# EAGLE schematic Resistor_Resistor (EAGLE 8.3.0), part 33 of 43
## Nets (continued)
N$67: R11801.2 R11802.2 R11803.2 R11804.2 R11805.2 R11806.2 R11807.2 R11808.2 R11809.2 R11810.2 R11811.2 R11812.2 R11813.2 R11814.2 R11815.2 R11816.2 R11817.2 R11818.2 R11819.2 R11820.2 R11821.2 R11822.2 R11823.2 R11824.2 R11825.2 R11826.2 R11827.2 R11828.2 R11829.2 R11830.2 R11831.2 R11832.2 R11833.2 R11834.2 R11835.2 R11836.2 R11837.2 R11838.2 R11839.2 R11840.2 R11841.2 R11842.2 R11843.2 R11844.2 R11845.2 R11846.2 R11847.2 R11848.2 R11849.2 R11850.2 R11851.2 R11852.2 R11853.2 R11854.2 R11855.2 R11856.2 R11857.2 R11858.2 R11859.2 R11860.2 R11861.2 R11862.2 R11863.2 R11864.2 R11865.2 R11866.2 R11867.2 R11868.2 R11869.2 R11870.2 R11871.2 R11872.2 R11873.2 R11874.2 R11875.2 R11876.2 R11877.2 R11878.2 R11879.2 R11880.2 R11881.2 R11882.2 R11883.2 R11884.2 R11885.2 R11886.2 R11887.2 R11888.2 R11889.2 R11890.2 R11891.2 R11892.2 R11893.2 R11894.2 R11895.2 R11896.2 R11897.2 R11898.2 R11899.2 R11900.2 R11901.2 R11902.2 R11903.2 R11904.2 R11905.2 R11906.2 R11907.2 R11908.2 R11909.2 R11910.2 R11911.2 R11912.2 R11913.2 R11914.2 R11915.2 R11916.2 R11917.2 R11918.2 R11919.2 R11920.2 R11921.2 R11922.2 R11923.2 R11924.2 R11925.2 R11926.2 R11927.2 R11928.2 R11929.2 R11930.2 R11931.2 R11932.2 R11933.2 R11934.2 R11935.2 R11936.2 R11937.2 R11938.2 R11939.2 R11940.2 R11941.2 R11942.2 R11943.2 R11944.2 R11945.2 R11946.2 R11947.2 R11948.2 R11949.2 R11950.2 R11951.2 R11952.2 R11953.2 R11954.2 R11955.2 R11956.2 R11957.2 R11958.2 R11959.2 R11960.2 R11961.2 R11962.2 R11963.2 R11964.2 R11965.2 R11966.2 R11967.2 R11968.2 R11969.2 R11970.2 R11971.2 R11972.2 R11973.2 R11974.2 R11975.2 R11976.2 R11977.2 R11978.2 R11979.2 R11980.2 R11981.2 R11982.2 R11983.2 R11984.2 R11985.2 R11986.2 R11987.2 R11988.2 R11989.2 R11990.2 R11991.2 R11992.2 R11993.2 R11994.2 R11995.2 R11996.2 R11997.2 R11998.2 R11999.2 R12000.2 R12001.1 R12002.1 R12003.1 R12004.1 R12005.1 R12006.1 R12007.1 R12008.1 R12009.1 R12010.1 R12011.1 R12012.1 R12013.1 R12014.1 R12015.1 R12016.1 R12017.1 R12018.1 R12019.1 R12020.1 R12021.1 R12022.1 R12023.1 R12024.1 R12025.1 R12026.1 R12027.1 R12028.1 R12029.1 R12030.1 R12031.1 R12032.1 R12033.1 R12034.1 R12035.1 R12036.1 R12037.1 R12038.1 R12039.1 R12040.1 R12041.1 R12042.1 R12043.1 R12044.1 R12045.1 R12046.1 R12047.1 R12048.1 R12049.1 R12050.1 R12051.1 R12052.1 R12053.1 R12054.1 R12055.1 R12056.1 R12057.1 R12058.1 R12059.1 R12060.1 R12061.1 R12062.1 R12063.1 R12064.1 R12065.1 R12066.1 R12067.1 R12068.1 R12069.1 R12070.1 R12071.1 R12072.1 R12073.1 R12074.1 R12075.1 R12076.1 R12077.1 R12078.1 R12079.1 R12080.1 R12081.1 R12082.1 R12083.1 R12084.1 R12085.1 R12086.1 R12087.1 R12088.1 R12089.1 R12090.1 R12091.1 R12092.1 R12093.1 R12094.1 R12095.1 R12096.1 R12097.1 R12098.1 R12099.1 R12100.1 R12101.1 R12102.1 R12103.1 R12104.1 R12105.1 R12106.1 R12107.1 R12108.1 R12109.1 R12110.1 R12111.1 R12112.1 R12113.1 R12114.1 R12115.1 R12116.1 R12117.1 R12118.1 R12119.1 R12120.1 R12121.1 R12122.1 R12123.1 R12124.1 R12125.1 R12126.1 R12127.1 R12128.1 R12129.1 R12130.1 R12131.1 R12132.1 R12133.1 R12134.1 R12135.1 R12136.1 R12137.1 R12138.1 R12139.1 R12140.1 R12141.1 R12142.1 R12143.1 R12144.1 R12145.1 R12146.1 R12147.1 R12148.1 R12149.1 R12150.1 R12151.1 R12152.1 R12153.1 R12154.1 R12155.1 R12156.1 R12157.1 R12158.1 R12159.1 R12160.1 R12161.1 R12162.1 R12163.1 R12164.1 R12165.1 R12166.1 R12167.1 R12168.1 R12169.1 R12170.1 R12171.1 R12172.1 R12173.1 R12174.1 R12175.1 R12176.1 R12177.1 R12178.1 R12179.1 R12180.1 R12181.1 R12182.1 R12183.1 R12184.1 R12185.1 R12186.1 R12187.1 R12188.1 R12189.1 R12190.1 R12191.1 R12192.1 R12193.1 R12194.1 R12195.1 R12196.1 R12197.1 R12198.1 R12199.1 R12200.1
N$68: R12001.2 R12002.2 R12003.2 R12004.2 R12005.2 R12006.2 R12007.2 R12008.2 R12009.2 R12010.2 R12011.2 R12012.2 R12013.2 R12014.2 R12015.2 R12016.2 R12017.2 R12018.2 R12019.2 R12020.2 R12021.2 R12022.2 R12023.2 R12024.2 R12025.2 R12026.2 R12027.2 R12028.2 R12029.2 R12030.2 R12031.2 R12032.2 R12033.2 R12034.2 R12035.2 R12036.2 R12037.2 R12038.2 R12039.2 R12040.2 R12041.2 R12042.2 R12043.2 R12044.2 R12045.2 R12046.2 R12047.2 R12048.2 R12049.2 R12050.2 R12051.2 R12052.2 R12053.2 R12054.2 R12055.2 R12056.2 R12057.2 R12058.2 R12059.2 R12060.2 R12061.2 R12062.2 R12063.2 R12064.2 R12065.2 R12066.2 R12067.2 R12068.2 R12069.2 R12070.2 R12071.2 R12072.2 R12073.2 R12074.2 R12075.2 R12076.2 R12077.2 R12078.2 R12079.2 R12080.2 R12081.2 R12082.2 R12083.2 R12084.2 R12085.2 R12086.2 R12087.2 R12088.2 R12089.2 R12090.2 R12091.2 R12092.2 R12093.2 R12094.2 R12095.2 R12096.2 R12097.2 R12098.2 R12099.2 R12100.2 R12101.2 R12102.2 R12103.2 R12104.2 R12105.2 R12106.2 R12107.2 R12108.2 R12109.2 R12110.2 R12111.2 R12112.2 R12113.2 R12114.2 R12115.2 R12116.2 R12117.2 R12118.2 R12119.2 R12120.2 R12121.2 R12122.2 R12123.2 R12124.2 R12125.2 R12126.2 R12127.2 R12128.2 R12129.2 R12130.2 R12131.2 R12132.2 R12133.2 R12134.2 R12135.2 R12136.2 R12137.2 R12138.2 R12139.2 R12140.2 R12141.2 R12142.2 R12143.2 R12144.2 R12145.2 R12146.2 R12147.2 R12148.2 R12149.2 R12150.2 R12151.2 R12152.2 R12153.2 R12154.2 R12155.2 R12156.2 R12157.2 R12158.2 R12159.2 R12160.2 R12161.2 R12162.2 R12163.2 R12164.2 R12165.2 R12166.2 R12167.2 R12168.2 R12169.2 R12170.2 R12171.2 R12172.2 R12173.2 R12174.2 R12175.2 R12176.2 R12177.2 R12178.2 R12179.2 R12180.2 R12181.2 R12182.2 R12183.2 R12184.2 R12185.2 R12186.2 R12187.2 R12188.2 R12189.2 R12190.2 R12191.2 R12192.2 R12193.2 R12194.2 R12195.2 R12196.2 R12197.2 R12198.2 R12199.2 R12200.2 R12201.1 R12202.1 R12203.1 R12204.1 R12205.1 R12206.1 R12207.1 R12208.1 R12209.1 R12210.1 R12211.1 R12212.1 R12213.1 R12214.1 R12215.1 R12216.1 R12217.1 R12218.1 R12219.1 R12220.1 R12221.1 R12222.1 R12223.1 R12224.1 R12225.1 R12226.1 R12227.1 R12228.1 R12229.1 R12230.1 R12231.1 R12232.1 R12233.1 R12234.1 R12235.1 R12236.1 R12237.1 R12238.1 R12239.1 R12240.1 R12241.1 R12242.1 R12243.1 R12244.1 R12245.1 R12246.1 R12247.1 R12248.1 R12249.1 R12250.1 R12251.1 R12252.1 R12253.1 R12254.1 R12255.1 R12256.1 R12257.1 R12258.1 R12259.1 R12260.1 R12261.1 R12262.1 R12263.1 R12264.1 R12265.1 R12266.1 R12267.1 R12268.1 R12269.1 R12270.1 R12271.1 R12272.1 R12273.1 R12274.1 R12275.1 R12276.1 R12277.1 R12278.1 R12279.1 R12280.1 R12281.1 R12282.1 R12283.1 R12284.1 R12285.1 R12286.1 R12287.1 R12288.1 R12289.1 R12290.1 R12291.1 R12292.1 R12293.1 R12294.1 R12295.1 R12296.1 R12297.1 R12298.1 R12299.1 R12300.1 R12301.1 R12302.1 R12303.1 R12304.1 R12305.1 R12306.1 R12307.1 R12308.1 R12309.1 R12310.1 R12311.1 R12312.1 R12313.1 R12314.1 R12315.1 R12316.1 R12317.1 R12318.1 R12319.1 R12320.1 R12321.1 R12322.1 R12323.1 R12324.1 R12325.1 R12326.1 R12327.1 R12328.1 R12329.1 R12330.1 R12331.1 R12332.1 R12333.1 R12334.1 R12335.1 R12336.1 R12337.1 R12338.1 R12339.1 R12340.1 R12341.1 R12342.1 R12343.1 R12344.1 R12345.1 R12346.1 R12347.1 R12348.1 R12349.1 R12350.1 R12351.1 R12352.1 R12353.1 R12354.1 R12355.1 R12356.1 R12357.1 R12358.1 R12359.1 R12360.1 R12361.1 R12362.1 R12363.1 R12364.1 R12365.1 R12366.1 R12367.1 R12368.1 R12369.1 R12370.1 R12371.1 R12372.1 R12373.1 R12374.1 R12375.1 R12376.1 R12377.1 R12378.1 R12379.1 R12380.1 R12381.1 R12382.1 R12383.1 R12384.1 R12385.1 R12386.1 R12387.1 R12388.1 R12389.1 R12390.1 R12391.1 R12392.1 R12393.1 R12394.1 R12395.1 R12396.1 R12397.1 R12398.1 R12399.1 R12400.1
N$69: R12201.2 R12202.2 R12203.2 R12204.2 R12205.2 R12206.2 R12207.2 R12208.2 R12209.2 R12210.2 R12211.2 R12212.2 R12213.2 R12214.2 R12215.2 R12216.2 R12217.2 R12218.2 R12219.2 R12220.2 R12221.2 R12222.2 R12223.2 R12224.2 R12225.2 R12226.2 R12227.2 R12228.2 R12229.2 R12230.2 R12231.2 R12232.2 R12233.2 R12234.2 R12235.2 R12236.2 R12237.2 R12238.2 R12239.2 R12240.2 R12241.2 R12242.2 R12243.2 R12244.2 R12245.2 R12246.2 R12247.2 R12248.2 R12249.2 R12250.2 R12251.2 R12252.2 R12253.2 R12254.2 R12255.2 R12256.2 R12257.2 R12258.2 R12259.2 R12260.2 R12261.2 R12262.2 R12263.2 R12264.2 R12265.2 R12266.2 R12267.2 R12268.2 R12269.2 R12270.2 R12271.2 R12272.2 R12273.2 R12274.2 R12275.2 R12276.2 R12277.2 R12278.2 R12279.2 R12280.2 R12281.2 R12282.2 R12283.2 R12284.2 R12285.2 R12286.2 R12287.2 R12288.2 R12289.2 R12290.2 R12291.2 R12292.2 R12293.2 R12294.2 R12295.2 R12296.2 R12297.2 R12298.2 R12299.2 R12300.2 R12301.2 R12302.2 R12303.2 R12304.2 R12305.2 R12306.2 R12307.2 R12308.2 R12309.2 R12310.2 R12311.2 R12312.2 R12313.2 R12314.2 R12315.2 R12316.2 R12317.2 R12318.2 R12319.2 R12320.2 R12321.2 R12322.2 R12323.2 R12324.2 R12325.2 R12326.2 R12327.2 R12328.2 R12329.2 R12330.2 R12331.2 R12332.2 R12333.2 R12334.2 R12335.2 R12336.2 R12337.2 R12338.2 R12339.2 R12340.2 R12341.2 R12342.2 R12343.2 R12344.2 R12345.2 R12346.2 R12347.2 R12348.2 R12349.2 R12350.2 R12351.2 R12352.2 R12353.2 R12354.2 R12355.2 R12356.2 R12357.2 R12358.2 R12359.2 R12360.2 R12361.2 R12362.2 R12363.2 R12364.2 R12365.2 R12366.2 R12367.2 R12368.2 R12369.2 R12370.2 R12371.2 R12372.2 R12373.2 R12374.2 R12375.2 R12376.2 R12377.2 R12378.2 R12379.2 R12380.2 R12381.2 R12382.2 R12383.2 R12384.2 R12385.2 R12386.2 R12387.2 R12388.2 R12389.2 R12390.2 R12391.2 R12392.2 R12393.2 R12394.2 R12395.2 R12396.2 R12397.2 R12398.2 R12399.2 R12400.2 R12401.1 R12402.1 R12403.1 R12404.1 R12405.1 R12406.1 R12407.1 R12408.1 R12409.1 R12410.1 R12411.1 R12412.1 R12413.1 R12414.1 R12415.1 R12416.1 R12417.1 R12418.1 R12419.1 R12420.1 R12421.1 R12422.1 R12423.1 R12424.1 R12425.1 R12426.1 R12427.1 R12428.1 R12429.1 R12430.1 R12431.1 R12432.1 R12433.1 R12434.1 R12435.1 R12436.1 R12437.1 R12438.1 R12439.1 R12440.1 R12441.1 R12442.1 R12443.1 R12444.1 R12445.1 R12446.1 R12447.1 R12448.1 R12449.1 R12450.1 R12451.1 R12452.1 R12453.1 R12454.1 R12455.1 R12456.1 R12457.1 R12458.1 R12459.1 R12460.1 R12461.1 R12462.1 R12463.1 R12464.1 R12465.1 R12466.1 R12467.1 R12468.1 R12469.1 R12470.1 R12471.1 R12472.1 R12473.1 R12474.1 R12475.1 R12476.1 R12477.1 R12478.1 R12479.1 R12480.1 R12481.1 R12482.1 R12483.1 R12484.1 R12485.1 R12486.1 R12487.1 R12488.1 R12489.1 R12490.1 R12491.1 R12492.1 R12493.1 R12494.1 R12495.1 R12496.1 R12497.1 R12498.1 R12499.1 R12500.1 R12501.1 R12502.1 R12503.1 R12504.1 R12505.1 R12506.1 R12507.1 R12508.1 R12509.1 R12510.1 R12511.1 R12512.1 R12513.1 R12514.1 R12515.1 R12516.1 R12517.1 R12518.1 R12519.1 R12520.1 R12521.1 R12522.1 R12523.1 R12524.1 R12525.1 R12526.1 R12527.1 R12528.1 R12529.1 R12530.1 R12531.1 R12532.1 R12533.1 R12534.1 R12535.1 R12536.1 R12537.1 R12538.1 R12539.1 R12540.1 R12541.1 R12542.1 R12543.1 R12544.1 R12545.1 R12546.1 R12547.1 R12548.1 R12549.1 R12550.1 R12551.1 R12552.1 R12553.1 R12554.1 R12555.1 R12556.1 R12557.1 R12558.1 R12559.1 R12560.1 R12561.1 R12562.1 R12563.1 R12564.1 R12565.1 R12566.1 R12567.1 R12568.1 R12569.1 R12570.1 R12571.1 R12572.1 R12573.1 R12574.1 R12575.1 R12576.1 R12577.1 R12578.1 R12579.1 R12580.1 R12581.1 R12582.1 R12583.1 R12584.1 R12585.1 R12586.1 R12587.1 R12588.1 R12589.1 R12590.1 R12591.1 R12592.1 R12593.1 R12594.1 R12595.1 R12596.1 R12597.1 R12598.1 R12599.1 R12600.1
N$70: R12401.2 R12402.2 R12403.2 R12404.2 R12405.2 R12406.2 R12407.2 R12408.2 R12409.2 R12410.2 R12411.2 R12412.2 R12413.2 R12414.2 R12415.2 R12416.2 R12417.2 R12418.2 R12419.2 R12420.2 R12421.2 R12422.2 R12423.2 R12424.2 R12425.2 R12426.2 R12427.2 R12428.2 R12429.2 R12430.2 R12431.2 R12432.2 R12433.2 R12434.2 R12435.2 R12436.2 R12437.2 R12438.2 R12439.2 R12440.2 R12441.2 R12442.2 R12443.2 R12444.2 R12445.2 R12446.2 R12447.2 R12448.2 R12449.2 R12450.2 R12451.2 R12452.2 R12453.2 R12454.2 R12455.2 R12456.2 R12457.2 R12458.2 R12459.2 R12460.2 R12461.2 R12462.2 R12463.2 R12464.2 R12465.2 R12466.2 R12467.2 R12468.2 R12469.2 R12470.2 R12471.2 R12472.2 R12473.2 R12474.2 R12475.2 R12476.2 R12477.2 R12478.2 R12479.2 R12480.2 R12481.2 R12482.2 R12483.2 R12484.2 R12485.2 R12486.2 R12487.2 R12488.2 R12489.2 R12490.2 R12491.2 R12492.2 R12493.2 R12494.2 R12495.2 R12496.2 R12497.2 R12498.2 R12499.2 R12500.2 R12501.2 R12502.2 R12503.2 R12504.2 R12505.2 R12506.2 R12507.2 R12508.2 R12509.2 R12510.2 R12511.2 R12512.2 R12513.2 R12514.2 R12515.2 R12516.2 R12517.2 R12518.2 R12519.2 R12520.2 R12521.2 R12522.2 R12523.2 R12524.2 R12525.2 R12526.2 R12527.2 R12528.2 R12529.2 R12530.2 R12531.2 R12532.2 R12533.2 R12534.2 R12535.2 R12536.2 R12537.2 R12538.2 R12539.2 R12540.2 R12541.2 R12542.2 R12543.2 R12544.2 R12545.2 R12546.2 R12547.2 R12548.2 R12549.2 R12550.2 R12551.2 R12552.2 R12553.2 R12554.2 R12555.2 R12556.2 R12557.2 R12558.2 R12559.2 R12560.2 R12561.2 R12562.2 R12563.2 R12564.2 R12565.2 R12566.2 R12567.2 R12568.2 R12569.2 R12570.2 R12571.2 R12572.2 R12573.2 R12574.2 R12575.2 R12576.2 R12577.2 R12578.2 R12579.2 R12580.2 R12581.2 R12582.2 R12583.2 R12584.2 R12585.2 R12586.2 R12587.2 R12588.2 R12589.2 R12590.2 R12591.2 R12592.2 R12593.2 R12594.2 R12595.2 R12596.2 R12597.2 R12598.2 R12599.2 R12600.2 R12601.1 R12602.1 R12603.1 R12604.1 R12605.1 R12606.1 R12607.1 R12608.1 R12609.1 R12610.1 R12611.1 R12612.1 R12613.1 R12614.1 R12615.1 R12616.1 R12617.1 R12618.1 R12619.1 R12620.1 R12621.1 R12622.1 R12623.1 R12624.1 R12625.1 R12626.1 R12627.1 R12628.1 R12629.1 R12630.1 R12631.1 R12632.1 R12633.1 R12634.1 R12635.1 R12636.1 R12637.1 R12638.1 R12639.1 R12640.1 R12641.1 R12642.1 R12643.1 R12644.1 R12645.1 R12646.1 R12647.1 R12648.1 R12649.1 R12650.1 R12651.1 R12652.1 R12653.1 R12654.1 R12655.1 R12656.1 R12657.1 R12658.1 R12659.1 R12660.1 R12661.1 R12662.1 R12663.1 R12664.1 R12665.1 R12666.1 R12667.1 R12668.1 R12669.1 R12670.1 R12671.1 R12672.1 R12673.1 R12674.1 R12675.1 R12676.1 R12677.1 R12678.1 R12679.1 R12680.1 R12681.1 R12682.1 R12683.1 R12684.1 R12685.1 R12686.1 R12687.1 R12688.1 R12689.1 R12690.1 R12691.1 R12692.1 R12693.1 R12694.1 R12695.1 R12696.1 R12697.1 R12698.1 R12699.1 R12700.1 R12701.1 R12702.1 R12703.1 R12704.1 R12705.1 R12706.1 R12707.1 R12708.1 R12709.1 R12710.1 R12711.1 R12712.1 R12713.1 R12714.1 R12715.1 R12716.1 R12717.1 R12718.1 R12719.1 R12720.1 R12721.1 R12722.1 R12723.1 R12724.1 R12725.1 R12726.1 R12727.1 R12728.1 R12729.1 R12730.1 R12731.1 R12732.1 R12733.1 R12734.1 R12735.1 R12736.1 R12737.1 R12738.1 R12739.1 R12740.1 R12741.1 R12742.1 R12743.1 R12744.1 R12745.1 R12746.1 R12747.1 R12748.1 R12749.1 R12750.1 R12751.1 R12752.1 R12753.1 R12754.1 R12755.1 R12756.1 R12757.1 R12758.1 R12759.1 R12760.1 R12761.1 R12762.1 R12763.1 R12764.1 R12765.1 R12766.1 R12767.1 R12768.1 R12769.1 R12770.1 R12771.1 R12772.1 R12773.1 R12774.1 R12775.1 R12776.1 R12777.1 R12778.1 R12779.1 R12780.1 R12781.1 R12782.1 R12783.1 R12784.1 R12785.1 R12786.1 R12787.1 R12788.1 R12789.1 R12790.1 R12791.1 R12792.1 R12793.1 R12794.1 R12795.1 R12796.1 R12797.1 R12798.1 R12799.1 R12800.1
N$71: R12601.2 R12602.2 R12603.2 R12604.2 R12605.2 R12606.2 R12607.2 R12608.2 R12609.2 R12610.2 R12611.2 R12612.2 R12613.2 R12614.2 R12615.2 R12616.2 R12617.2 R12618.2 R12619.2 R12620.2 R12621.2 R12622.2 R12623.2 R12624.2 R12625.2 R12626.2 R12627.2 R12628.2 R12629.2 R12630.2 R12631.2 R12632.2 R12633.2 R12634.2 R12635.2 R12636.2 R12637.2 R12638.2 R12639.2 R12640.2 R12641.2 R12642.2 R12643.2 R12644.2 R12645.2 R12646.2 R12647.2 R12648.2 R12649.2 R12650.2 R12651.2 R12652.2 R12653.2 R12654.2 R12655.2 R12656.2 R12657.2 R12658.2 R12659.2 R12660.2 R12661.2 R12662.2 R12663.2 R12664.2 R12665.2 R12666.2 R12667.2 R12668.2 R12669.2 R12670.2 R12671.2 R12672.2 R12673.2 R12674.2 R12675.2 R12676.2 R12677.2 R12678.2 R12679.2 R12680.2 R12681.2 R12682.2 R12683.2 R12684.2 R12685.2 R12686.2 R12687.2 R12688.2 R12689.2 R12690.2 R12691.2 R12692.2 R12693.2 R12694.2 R12695.2 R12696.2 R12697.2 R12698.2 R12699.2 R12700.2 R12701.2 R12702.2 R12703.2 R12704.2 R12705.2 R12706.2 R12707.2 R12708.2 R12709.2 R12710.2 R12711.2 R12712.2 R12713.2 R12714.2 R12715.2 R12716.2 R12717.2 R12718.2 R12719.2 R12720.2 R12721.2 R12722.2 R12723.2 R12724.2 R12725.2 R12726.2 R12727.2 R12728.2 R12729.2 R12730.2 R12731.2 R12732.2 R12733.2 R12734.2 R12735.2 R12736.2 R12737.2 R12738.2 R12739.2 R12740.2 R12741.2 R12742.2 R12743.2 R12744.2 R12745.2 R12746.2 R12747.2 R12748.2 R12749.2 R12750.2 R12751.2 R12752.2 R12753.2 R12754.2 R12755.2 R12756.2 R12757.2 R12758.2 R12759.2 R12760.2 R12761.2 R12762.2 R12763.2 R12764.2 R12765.2 R12766.2 R12767.2 R12768.2 R12769.2 R12770.2 R12771.2 R12772.2 R12773.2 R12774.2 R12775.2 R12776.2 R12777.2 R12778.2 R12779.2 R12780.2 R12781.2 R12782.2 R12783.2 R12784.2 R12785.2 R12786.2 R12787.2 R12788.2 R12789.2 R12790.2 R12791.2 R12792.2 R12793.2 R12794.2 R12795.2 R12796.2 R12797.2 R12798.2 R12799.2 R12800.2 R12801.1 R12802.1 R12803.1 R12804.1 R12805.1 R12806.1 R12807.1 R12808.1 R12809.1 R12810.1 R12811.1 R12812.1 R12813.1 R12814.1 R12815.1 R12816.1 R12817.1 R12818.1 R12819.1 R12820.1 R12821.1 R12822.1 R12823.1 R12824.1 R12825.1 R12826.1 R12827.1 R12828.1 R12829.1 R12830.1 R12831.1 R12832.1 R12833.1 R12834.1 R12835.1 R12836.1 R12837.1 R12838.1 R12839.1 R12840.1 R12841.1 R12842.1 R12843.1 R12844.1 R12845.1 R12846.1 R12847.1 R12848.1 R12849.1 R12850.1 R12851.1 R12852.1 R12853.1 R12854.1 R12855.1 R12856.1 R12857.1 R12858.1 R12859.1 R12860.1 R12861.1 R12862.1 R12863.1 R12864.1 R12865.1 R12866.1 R12867.1 R12868.1 R12869.1 R12870.1 R12871.1 R12872.1 R12873.1 R12874.1 R12875.1 R12876.1 R12877.1 R12878.1 R12879.1 R12880.1 R12881.1 R12882.1 R12883.1 R12884.1 R12885.1 R12886.1 R12887.1 R12888.1 R12889.1 R12890.1 R12891.1 R12892.1 R12893.1 R12894.1 R12895.1 R12896.1 R12897.1 R12898.1 R12899.1 R12900.1 R12901.1 R12902.1 R12903.1 R12904.1 R12905.1 R12906.1 R12907.1 R12908.1 R12909.1 R12910.1 R12911.1 R12912.1 R12913.1 R12914.1 R12915.1 R12916.1 R12917.1 R12918.1 R12919.1 R12920.1 R12921.1 R12922.1 R12923.1 R12924.1 R12925.1 R12926.1 R12927.1 R12928.1 R12929.1 R12930.1 R12931.1 R12932.1 R12933.1 R12934.1 R12935.1 R12936.1 R12937.1 R12938.1 R12939.1 R12940.1 R12941.1 R12942.1 R12943.1 R12944.1 R12945.1 R12946.1 R12947.1 R12948.1 R12949.1 R12950.1 R12951.1 R12952.1 R12953.1 R12954.1 R12955.1 R12956.1 R12957.1 R12958.1 R12959.1 R12960.1 R12961.1 R12962.1 R12963.1 R12964.1 R12965.1 R12966.1 R12967.1 R12968.1 R12969.1 R12970.1 R12971.1 R12972.1 R12973.1 R12974.1 R12975.1 R12976.1 R12977.1 R12978.1 R12979.1 R12980.1 R12981.1 R12982.1 R12983.1 R12984.1 R12985.1 R12986.1 R12987.1 R12988.1 R12989.1 R12990.1 R12991.1 R12992.1 R12993.1 R12994.1 R12995.1 R12996.1 R12997.1 R12998.1 R12999.1 R13000.1
N$73: R12801.2 R12802.2 R12803.2 R12804.2 R12805.2 R12806.2 R12807.2 R12808.2 R12809.2 R12810.2 R12811.2 R12812.2 R12813.2 R12814.2 R12815.2 R12816.2 R12817.2 R12818.2 R12819.2 R12820.2 R12821.2 R12822.2 R12823.2 R12824.2 R12825.2 R12826.2 R12827.2 R12828.2 R12829.2 R12830.2 R12831.2 R12832.2 R12833.2 R12834.2 R12835.2 R12836.2 R12837.2 R12838.2 R12839.2 R12840.2 R12841.2 R12842.2 R12843.2 R12844.2 R12845.2 R12846.2 R12847.2 R12848.2 R12849.2 R12850.2 R12851.2 R12852.2 R12853.2 R12854.2 R12855.2 R12856.2 R12857.2 R12858.2 R12859.2 R12860.2 R12861.2 R12862.2 R12863.2 R12864.2 R12865.2 R12866.2 R12867.2 R12868.2 R12869.2 R12870.2 R12871.2 R12872.2 R12873.2 R12874.2 R12875.2 R12876.2 R12877.2 R12878.2 R12879.2 R12880.2 R12881.2 R12882.2 R12883.2 R12884.2 R12885.2 R12886.2 R12887.2 R12888.2 R12889.2 R12890.2 R12891.2 R12892.2 R12893.2 R12894.2 R12895.2 R12896.2 R12897.2 R12898.2 R12899.2 R12900.2 R12901.2 R12902.2 R12903.2 R12904.2 R12905.2 R12906.2 R12907.2 R12908.2 R12909.2 R12910.2 R12911.2 R12912.2 R12913.2 R12914.2 R12915.2 R12916.2 R12917.2 R12918.2 R12919.2 R12920.2 R12921.2 R12922.2 R12923.2 R12924.2 R12925.2 R12926.2 R12927.2 R12928.2 R12929.2 R12930.2 R12931.2 R12932.2 R12933.2 R12934.2 R12935.2 R12936.2 R12937.2 R12938.2 R12939.2 R12940.2 R12941.2 R12942.2 R12943.2 R12944.2 R12945.2 R12946.2 R12947.2 R12948.2 R12949.2 R12950.2 R12951.2 R12952.2 R12953.2 R12954.2 R12955.2 R12956.2 R12957.2 R12958.2 R12959.2 R12960.2 R12961.2 R12962.2 R12963.2 R12964.2 R12965.2 R12966.2 R12967.2 R12968.2 R12969.2 R12970.2 R12971.2 R12972.2 R12973.2 R12974.2 R12975.2 R12976.2 R12977.2 R12978.2 R12979.2 R12980.2 R12981.2 R12982.2 R12983.2 R12984.2 R12985.2 R12986.2 R12987.2 R12988.2 R12989.2 R12990.2 R12991.2 R12992.2 R12993.2 R12994.2 R12995.2 R12996.2 R12997.2 R12998.2 R12999.2 R13000.2 R13001.1 R13002.1 R13003.1 R13004.1 R13005.1 R13006.1 R13007.1 R13008.1 R13009.1 R13010.1 R13011.1 R13012.1 R13013.1 R13014.1 R13015.1 R13016.1 R13017.1 R13018.1 R13019.1 R13020.1 R13021.1 R13022.1 R13023.1 R13024.1 R13025.1 R13026.1 R13027.1 R13028.1 R13029.1 R13030.1 R13031.1 R13032.1 R13033.1 R13034.1 R13035.1 R13036.1 R13037.1 R13038.1 R13039.1 R13040.1 R13041.1 R13042.1 R13043.1 R13044.1 R13045.1 R13046.1 R13047.1 R13048.1 R13049.1 R13050.1 R13051.1 R13052.1 R13053.1 R13054.1 R13055.1 R13056.1 R13057.1 R13058.1 R13059.1 R13060.1 R13061.1 R13062.1 R13063.1 R13064.1 R13065.1 R13066.1 R13067.1 R13068.1 R13069.1 R13070.1 R13071.1 R13072.1 R13073.1 R13074.1 R13075.1 R13076.1 R13077.1 R13078.1 R13079.1 R13080.1 R13081.1 R13082.1 R13083.1 R13084.1 R13085.1 R13086.1 R13087.1 R13088.1 R13089.1 R13090.1 R13091.1 R13092.1 R13093.1 R13094.1 R13095.1 R13096.1 R13097.1 R13098.1 R13099.1 R13100.1 R13101.1 R13102.1 R13103.1 R13104.1 R13105.1 R13106.1 R13107.1 R13108.1 R13109.1 R13110.1 R13111.1 R13112.1 R13113.1 R13114.1 R13115.1 R13116.1 R13117.1 R13118.1 R13119.1 R13120.1 R13121.1 R13122.1 R13123.1 R13124.1 R13125.1 R13126.1 R13127.1 R13128.1 R13129.1 R13130.1 R13131.1 R13132.1 R13133.1 R13134.1 R13135.1 R13136.1 R13137.1 R13138.1 R13139.1 R13140.1 R13141.1 R13142.1 R13143.1 R13144.1 R13145.1 R13146.1 R13147.1 R13148.1 R13149.1 R13150.1 R13151.1 R13152.1 R13153.1 R13154.1 R13155.1 R13156.1 R13157.1 R13158.1 R13159.1 R13160.1 R13161.1 R13162.1 R13163.1 R13164.1 R13165.1 R13166.1 R13167.1 R13168.1 R13169.1 R13170.1 R13171.1 R13172.1 R13173.1 R13174.1 R13175.1 R13176.1 R13177.1 R13178.1 R13179.1 R13180.1 R13181.1 R13182.1 R13183.1 R13184.1 R13185.1 R13186.1 R13187.1 R13188.1 R13189.1 R13190.1 R13191.1 R13192.1 R13193.1 R13194.1 R13195.1 R13196.1 R13197.1 R13198.1 R13199.1 R13200.1
N$74: R13001.2 R13002.2 R13003.2 R13004.2 R13005.2 R13006.2 R13007.2 R13008.2 R13009.2 R13010.2 R13011.2 R13012.2 R13013.2 R13014.2 R13015.2 R13016.2 R13017.2 R13018.2 R13019.2 R13020.2 R13021.2 R13022.2 R13023.2 R13024.2 R13025.2 R13026.2 R13027.2 R13028.2 R13029.2 R13030.2 R13031.2 R13032.2 R13033.2 R13034.2 R13035.2 R13036.2 R13037.2 R13038.2 R13039.2 R13040.2 R13041.2 R13042.2 R13043.2 R13044.2 R13045.2 R13046.2 R13047.2 R13048.2 R13049.2 R13050.2 R13051.2 R13052.2 R13053.2 R13054.2 R13055.2 R13056.2 R13057.2 R13058.2 R13059.2 R13060.2 R13061.2 R13062.2 R13063.2 R13064.2 R13065.2 R13066.2 R13067.2 R13068.2 R13069.2 R13070.2 R13071.2 R13072.2 R13073.2 R13074.2 R13075.2 R13076.2 R13077.2 R13078.2 R13079.2 R13080.2 R13081.2 R13082.2 R13083.2 R13084.2 R13085.2 R13086.2 R13087.2 R13088.2 R13089.2 R13090.2 R13091.2 R13092.2 R13093.2 R13094.2 R13095.2 R13096.2 R13097.2 R13098.2 R13099.2 R13100.2 R13101.2 R13102.2 R13103.2 R13104.2 R13105.2 R13106.2 R13107.2 R13108.2 R13109.2 R13110.2 R13111.2 R13112.2 R13113.2 R13114.2 R13115.2 R13116.2 R13117.2 R13118.2 R13119.2 R13120.2 R13121.2 R13122.2 R13123.2 R13124.2 R13125.2 R13126.2 R13127.2 R13128.2 R13129.2 R13130.2 R13131.2 R13132.2 R13133.2 R13134.2 R13135.2 R13136.2 R13137.2 R13138.2 R13139.2 R13140.2 R13141.2 R13142.2 R13143.2 R13144.2 R13145.2 R13146.2 R13147.2 R13148.2 R13149.2 R13150.2 R13151.2 R13152.2 R13153.2 R13154.2 R13155.2 R13156.2 R13157.2 R13158.2 R13159.2 R13160.2 R13161.2 R13162.2 R13163.2 R13164.2 R13165.2 R13166.2 R13167.2 R13168.2 R13169.2 R13170.2 R13171.2 R13172.2 R13173.2 R13174.2 R13175.2 R13176.2 R13177.2 R13178.2 R13179.2 R13180.2 R13181.2 R13182.2 R13183.2 R13184.2 R13185.2 R13186.2 R13187.2 R13188.2 R13189.2 R13190.2 R13191.2 R13192.2 R13193.2 R13194.2 R13195.2 R13196.2 R13197.2 R13198.2 R13199.2 R13200.2 R13201.1 R13202.1 R13203.1 R13204.1 R13205.1 R13206.1 R13207.1 R13208.1 R13209.1 R13210.1 R13211.1 R13212.1 R13213.1 R13214.1 R13215.1 R13216.1 R13217.1 R13218.1 R13219.1 R13220.1 R13221.1 R13222.1 R13223.1 R13224.1 R13225.1 R13226.1 R13227.1 R13228.1 R13229.1 R13230.1 R13231.1 R13232.1 R13233.1 R13234.1 R13235.1 R13236.1 R13237.1 R13238.1 R13239.1 R13240.1 R13241.1 R13242.1 R13243.1 R13244.1 R13245.1 R13246.1 R13247.1 R13248.1 R13249.1 R13250.1 R13251.1 R13252.1 R13253.1 R13254.1 R13255.1 R13256.1 R13257.1 R13258.1 R13259.1 R13260.1 R13261.1 R13262.1 R13263.1 R13264.1 R13265.1 R13266.1 R13267.1 R13268.1 R13269.1 R13270.1 R13271.1 R13272.1 R13273.1 R13274.1 R13275.1 R13276.1 R13277.1 R13278.1 R13279.1 R13280.1 R13281.1 R13282.1 R13283.1 R13284.1 R13285.1 R13286.1 R13287.1 R13288.1 R13289.1 R13290.1 R13291.1 R13292.1 R13293.1 R13294.1 R13295.1 R13296.1 R13297.1 R13298.1 R13299.1 R13300.1 R13301.1 R13302.1 R13303.1 R13304.1 R13305.1 R13306.1 R13307.1 R13308.1 R13309.1 R13310.1 R13311.1 R13312.1 R13313.1 R13314.1 R13315.1 R13316.1 R13317.1 R13318.1 R13319.1 R13320.1 R13321.1 R13322.1 R13323.1 R13324.1 R13325.1 R13326.1 R13327.1 R13328.1 R13329.1 R13330.1 R13331.1 R13332.1 R13333.1 R13334.1 R13335.1 R13336.1 R13337.1 R13338.1 R13339.1 R13340.1 R13341.1 R13342.1 R13343.1 R13344.1 R13345.1 R13346.1 R13347.1 R13348.1 R13349.1 R13350.1 R13351.1 R13352.1 R13353.1 R13354.1 R13355.1 R13356.1 R13357.1 R13358.1 R13359.1 R13360.1 R13361.1 R13362.1 R13363.1 R13364.1 R13365.1 R13366.1 R13367.1 R13368.1 R13369.1 R13370.1 R13371.1 R13372.1 R13373.1 R13374.1 R13375.1 R13376.1 R13377.1 R13378.1 R13379.1 R13380.1 R13381.1 R13382.1 R13383.1 R13384.1 R13385.1 R13386.1 R13387.1 R13388.1 R13389.1 R13390.1 R13391.1 R13392.1 R13393.1 R13394.1 R13395.1 R13396.1 R13397.1 R13398.1 R13399.1 R13400.1
N$75: R13201.2 R13202.2 R13203.2 R13204.2 R13205.2 R13206.2 R13207.2 R13208.2 R13209.2 R13210.2 R13211.2 R13212.2 R13213.2 R13214.2 R13215.2 R13216.2 R13217.2 R13218.2 R13219.2 R13220.2 R13221.2 R13222.2 R13223.2 R13224.2 R13225.2 R13226.2 R13227.2 R13228.2 R13229.2 R13230.2 R13231.2 R13232.2 R13233.2 R13234.2 R13235.2 R13236.2 R13237.2 R13238.2 R13239.2 R13240.2 R13241.2 R13242.2 R13243.2 R13244.2 R13245.2 R13246.2 R13247.2 R13248.2 R13249.2 R13250.2 R13251.2 R13252.2 R13253.2 R13254.2 R13255.2 R13256.2 R13257.2 R13258.2 R13259.2 R13260.2 R13261.2 R13262.2 R13263.2 R13264.2 R13265.2 R13266.2 R13267.2 R13268.2 R13269.2 R13270.2 R13271.2 R13272.2 R13273.2 R13274.2 R13275.2 R13276.2 R13277.2 R13278.2 R13279.2 R13280.2 R13281.2 R13282.2 R13283.2 R13284.2 R13285.2 R13286.2 R13287.2 R13288.2 R13289.2 R13290.2 R13291.2 R13292.2 R13293.2 R13294.2 R13295.2 R13296.2 R13297.2 R13298.2 R13299.2 R13300.2 R13301.2 R13302.2 R13303.2 R13304.2 R13305.2 R13306.2 R13307.2 R13308.2 R13309.2 R13310.2 R13311.2 R13312.2 R13313.2 R13314.2 R13315.2 R13316.2 R13317.2 R13318.2 R13319.2 R13320.2 R13321.2 R13322.2 R13323.2 R13324.2 R13325.2 R13326.2 R13327.2 R13328.2 R13329.2 R13330.2 R13331.2 R13332.2 R13333.2 R13334.2 R13335.2 R13336.2 R13337.2 R13338.2 R13339.2 R13340.2 R13341.2 R13342.2 R13343.2 R13344.2 R13345.2 R13346.2 R13347.2 R13348.2 R13349.2 R13350.2 R13351.2 R13352.2 R13353.2 R13354.2 R13355.2 R13356.2 R13357.2 R13358.2 R13359.2 R13360.2 R13361.2 R13362.2 R13363.2 R13364.2 R13365.2 R13366.2 R13367.2 R13368.2 R13369.2 R13370.2 R13371.2 R13372.2 R13373.2 R13374.2 R13375.2 R13376.2 R13377.2 R13378.2 R13379.2 R13380.2 R13381.2 R13382.2 R13383.2 R13384.2 R13385.2 R13386.2 R13387.2 R13388.2 R13389.2 R13390.2 R13391.2 R13392.2 R13393.2 R13394.2 R13395.2 R13396.2 R13397.2 R13398.2 R13399.2 R13400.2 R13401.1 R13402.1 R13403.1 R13404.1 R13405.1 R13406.1 R13407.1 R13408.1 R13409.1 R13410.1 R13411.1 R13412.1 R13413.1 R13414.1 R13415.1 R13416.1 R13417.1 R13418.1 R13419.1 R13420.1 R13421.1 R13422.1 R13423.1 R13424.1 R13425.1 R13426.1 R13427.1 R13428.1 R13429.1 R13430.1 R13431.1 R13432.1 R13433.1 R13434.1 R13435.1 R13436.1 R13437.1 R13438.1 R13439.1 R13440.1 R13441.1 R13442.1 R13443.1 R13444.1 R13445.1 R13446.1 R13447.1 R13448.1 R13449.1 R13450.1 R13451.1 R13452.1 R13453.1 R13454.1 R13455.1 R13456.1 R13457.1 R13458.1 R13459.1 R13460.1 R13461.1 R13462.1 R13463.1 R13464.1 R13465.1 R13466.1 R13467.1 R13468.1 R13469.1 R13470.1 R13471.1 R13472.1 R13473.1 R13474.1 R13475.1 R13476.1 R13477.1 R13478.1 R13479.1 R13480.1 R13481.1 R13482.1 R13483.1 R13484.1 R13485.1 R13486.1 R13487.1 R13488.1 R13489.1 R13490.1 R13491.1 R13492.1 R13493.1 R13494.1 R13495.1 R13496.1 R13497.1 R13498.1 R13499.1 R13500.1 R13501.1 R13502.1 R13503.1 R13504.1 R13505.1 R13506.1 R13507.1 R13508.1 R13509.1 R13510.1 R13511.1 R13512.1 R13513.1 R13514.1 R13515.1 R13516.1 R13517.1 R13518.1 R13519.1 R13520.1 R13521.1 R13522.1 R13523.1 R13524.1 R13525.1 R13526.1 R13527.1 R13528.1 R13529.1 R13530.1 R13531.1 R13532.1 R13533.1 R13534.1 R13535.1 R13536.1 R13537.1 R13538.1 R13539.1 R13540.1 R13541.1 R13542.1 R13543.1 R13544.1 R13545.1 R13546.1 R13547.1 R13548.1 R13549.1 R13550.1 R13551.1 R13552.1 R13553.1 R13554.1 R13555.1 R13556.1 R13557.1 R13558.1 R13559.1 R13560.1 R13561.1 R13562.1 R13563.1 R13564.1 R13565.1 R13566.1 R13567.1 R13568.1 R13569.1 R13570.1 R13571.1 R13572.1 R13573.1 R13574.1 R13575.1 R13576.1 R13577.1 R13578.1 R13579.1 R13580.1 R13581.1 R13582.1 R13583.1 R13584.1 R13585.1 R13586.1 R13587.1 R13588.1 R13589.1 R13590.1 R13591.1 R13592.1 R13593.1 R13594.1 R13595.1 R13596.1 R13597.1 R13598.1 R13599.1 R13600.1
N$76: R13401.2 R13402.2 R13403.2 R13404.2 R13405.2 R13406.2 R13407.2 R13408.2 R13409.2 R13410.2 R13411.2 R13412.2 R13413.2 R13414.2 R13415.2 R13416.2 R13417.2 R13418.2 R13419.2 R13420.2 R13421.2 R13422.2 R13423.2 R13424.2 R13425.2 R13426.2 R13427.2 R13428.2 R13429.2 R13430.2 R13431.2 R13432.2 R13433.2 R13434.2 R13435.2 R13436.2 R13437.2 R13438.2 R13439.2 R13440.2 R13441.2 R13442.2 R13443.2 R13444.2 R13445.2 R13446.2 R13447.2 R13448.2 R13449.2 R13450.2 R13451.2 R13452.2 R13453.2 R13454.2 R13455.2 R13456.2 R13457.2 R13458.2 R13459.2 R13460.2 R13461.2 R13462.2 R13463.2 R13464.2 R13465.2 R13466.2 R13467.2 R13468.2 R13469.2 R13470.2 R13471.2 R13472.2 R13473.2 R13474.2 R13475.2 R13476.2 R13477.2 R13478.2 R13479.2 R13480.2 R13481.2 R13482.2 R13483.2 R13484.2 R13485.2 R13486.2 R13487.2 R13488.2 R13489.2 R13490.2 R13491.2 R13492.2 R13493.2 R13494.2 R13495.2 R13496.2 R13497.2 R13498.2 R13499.2 R13500.2 R13501.2 R13502.2 R13503.2 R13504.2 R13505.2 R13506.2 R13507.2 R13508.2 R13509.2 R13510.2 R13511.2 R13512.2 R13513.2 R13514.2 R13515.2 R13516.2 R13517.2 R13518.2 R13519.2 R13520.2 R13521.2 R13522.2 R13523.2 R13524.2 R13525.2 R13526.2 R13527.2 R13528.2 R13529.2 R13530.2 R13531.2 R13532.2 R13533.2 R13534.2 R13535.2 R13536.2 R13537.2 R13538.2 R13539.2 R13540.2 R13541.2 R13542.2 R13543.2 R13544.2 R13545.2 R13546.2 R13547.2 R13548.2 R13549.2 R13550.2 R13551.2 R13552.2 R13553.2 R13554.2 R13555.2 R13556.2 R13557.2 R13558.2 R13559.2 R13560.2 R13561.2 R13562.2 R13563.2 R13564.2 R13565.2 R13566.2 R13567.2 R13568.2 R13569.2 R13570.2 R13571.2 R13572.2 R13573.2 R13574.2 R13575.2 R13576.2 R13577.2 R13578.2 R13579.2 R13580.2 R13581.2 R13582.2 R13583.2 R13584.2 R13585.2 R13586.2 R13587.2 R13588.2 R13589.2 R13590.2 R13591.2 R13592.2 R13593.2 R13594.2 R13595.2 R13596.2 R13597.2 R13598.2 R13599.2 R13600.2 R13601.1 R13602.1 R13603.1 R13604.1 R13605.1 R13606.1 R13607.1 R13608.1 R13609.1 R13610.1 R13611.1 R13612.1 R13613.1 R13614.1 R13615.1 R13616.1 R13617.1 R13618.1 R13619.1 R13620.1 R13621.1 R13622.1 R13623.1 R13624.1 R13625.1 R13626.1 R13627.1 R13628.1 R13629.1 R13630.1 R13631.1 R13632.1 R13633.1 R13634.1 R13635.1 R13636.1 R13637.1 R13638.1 R13639.1 R13640.1 R13641.1 R13642.1 R13643.1 R13644.1 R13645.1 R13646.1 R13647.1 R13648.1 R13649.1 R13650.1 R13651.1 R13652.1 R13653.1 R13654.1 R13655.1 R13656.1 R13657.1 R13658.1 R13659.1 R13660.1 R13661.1 R13662.1 R13663.1 R13664.1 R13665.1 R13666.1 R13667.1 R13668.1 R13669.1 R13670.1 R13671.1 R13672.1 R13673.1 R13674.1 R13675.1 R13676.1 R13677.1 R13678.1 R13679.1 R13680.1 R13681.1 R13682.1 R13683.1 R13684.1 R13685.1 R13686.1 R13687.1 R13688.1 R13689.1 R13690.1 R13691.1 R13692.1 R13693.1 R13694.1 R13695.1 R13696.1 R13697.1 R13698.1 R13699.1 R13700.1 R13701.1 R13702.1 R13703.1 R13704.1 R13705.1 R13706.1 R13707.1 R13708.1 R13709.1 R13710.1 R13711.1 R13712.1 R13713.1 R13714.1 R13715.1 R13716.1 R13717.1 R13718.1 R13719.1 R13720.1 R13721.1 R13722.1 R13723.1 R13724.1 R13725.1 R13726.1 R13727.1 R13728.1 R13729.1 R13730.1 R13731.1 R13732.1 R13733.1 R13734.1 R13735.1 R13736.1 R13737.1 R13738.1 R13739.1 R13740.1 R13741.1 R13742.1 R13743.1 R13744.1 R13745.1 R13746.1 R13747.1 R13748.1 R13749.1 R13750.1 R13751.1 R13752.1 R13753.1 R13754.1 R13755.1 R13756.1 R13757.1 R13758.1 R13759.1 R13760.1 R13761.1 R13762.1 R13763.1 R13764.1 R13765.1 R13766.1 R13767.1 R13768.1 R13769.1 R13770.1 R13771.1 R13772.1 R13773.1 R13774.1 R13775.1 R13776.1 R13777.1 R13778.1 R13779.1 R13780.1 R13781.1 R13782.1 R13783.1 R13784.1 R13785.1 R13786.1 R13787.1 R13788.1 R13789.1 R13790.1 R13791.1 R13792.1 R13793.1 R13794.1 R13795.1 R13796.1 R13797.1 R13798.1 R13799.1 R13800.1
N$77: R13601.2 R13602.2 R13603.2 R13604.2 R13605.2 R13606.2 R13607.2 R13608.2 R13609.2 R13610.2 R13611.2 R13612.2 R13613.2 R13614.2 R13615.2 R13616.2 R13617.2 R13618.2 R13619.2 R13620.2 R13621.2 R13622.2 R13623.2 R13624.2 R13625.2 R13626.2 R13627.2 R13628.2 R13629.2 R13630.2 R13631.2 R13632.2 R13633.2 R13634.2 R13635.2 R13636.2 R13637.2 R13638.2 R13639.2 R13640.2 R13641.2 R13642.2 R13643.2 R13644.2 R13645.2 R13646.2 R13647.2 R13648.2 R13649.2 R13650.2 R13651.2 R13652.2 R13653.2 R13654.2 R13655.2 R13656.2 R13657.2 R13658.2 R13659.2 R13660.2 R13661.2 R13662.2 R13663.2 R13664.2 R13665.2 R13666.2 R13667.2 R13668.2 R13669.2 R13670.2 R13671.2 R13672.2 R13673.2 R13674.2 R13675.2 R13676.2 R13677.2 R13678.2 R13679.2 R13680.2 R13681.2 R13682.2 R13683.2 R13684.2 R13685.2 R13686.2 R13687.2 R13688.2 R13689.2 R13690.2 R13691.2 R13692.2 R13693.2 R13694.2 R13695.2 R13696.2 R13697.2 R13698.2 R13699.2 R13700.2 R13701.2 R13702.2 R13703.2 R13704.2 R13705.2 R13706.2 R13707.2 R13708.2 R13709.2 R13710.2 R13711.2 R13712.2 R13713.2 R13714.2 R13715.2 R13716.2 R13717.2 R13718.2 R13719.2 R13720.2 R13721.2 R13722.2 R13723.2 R13724.2 R13725.2 R13726.2 R13727.2 R13728.2 R13729.2 R13730.2 R13731.2 R13732.2 R13733.2 R13734.2 R13735.2 R13736.2 R13737.2 R13738.2 R13739.2 R13740.2 R13741.2 R13742.2 R13743.2 R13744.2 R13745.2 R13746.2 R13747.2 R13748.2 R13749.2 R13750.2 R13751.2 R13752.2 R13753.2 R13754.2 R13755.2 R13756.2 R13757.2 R13758.2 R13759.2 R13760.2 R13761.2 R13762.2 R13763.2 R13764.2 R13765.2 R13766.2 R13767.2 R13768.2 R13769.2 R13770.2 R13771.2 R13772.2 R13773.2 R13774.2 R13775.2 R13776.2 R13777.2 R13778.2 R13779.2 R13780.2 R13781.2 R13782.2 R13783.2 R13784.2 R13785.2 R13786.2 R13787.2 R13788.2 R13789.2 R13790.2 R13791.2 R13792.2 R13793.2 R13794.2 R13795.2 R13796.2 R13797.2 R13798.2 R13799.2 R13800.2 R13801.1 R13802.1 R13803.1 R13804.1 R13805.1 R13806.1 R13807.1 R13808.1 R13809.1 R13810.1 R13811.1 R13812.1 R13813.1 R13814.1 R13815.1 R13816.1 R13817.1 R13818.1 R13819.1 R13820.1 R13821.1 R13822.1 R13823.1 R13824.1 R13825.1 R13826.1 R13827.1 R13828.1 R13829.1 R13830.1 R13831.1 R13832.1 R13833.1 R13834.1 R13835.1 R13836.1 R13837.1 R13838.1 R13839.1 R13840.1 R13841.1 R13842.1 R13843.1 R13844.1 R13845.1 R13846.1 R13847.1 R13848.1 R13849.1 R13850.1 R13851.1 R13852.1 R13853.1 R13854.1 R13855.1 R13856.1 R13857.1 R13858.1 R13859.1 R13860.1 R13861.1 R13862.1 R13863.1 R13864.1 R13865.1 R13866.1 R13867.1 R13868.1 R13869.1 R13870.1 R13871.1 R13872.1 R13873.1 R13874.1 R13875.1 R13876.1 R13877.1 R13878.1 R13879.1 R13880.1 R13881.1 R13882.1 R13883.1 R13884.1 R13885.1 R13886.1 R13887.1 R13888.1 R13889.1 R13890.1 R13891.1 R13892.1 R13893.1 R13894.1 R13895.1 R13896.1 R13897.1 R13898.1 R13899.1 R13900.1 R13901.1 R13902.1 R13903.1 R13904.1 R13905.1 R13906.1 R13907.1 R13908.1 R13909.1 R13910.1 R13911.1 R13912.1 R13913.1 R13914.1 R13915.1 R13916.1 R13917.1 R13918.1 R13919.1 R13920.1 R13921.1 R13922.1 R13923.1 R13924.1 R13925.1 R13926.1 R13927.1 R13928.1 R13929.1 R13930.1 R13931.1 R13932.1 R13933.1 R13934.1 R13935.1 R13936.1 R13937.1 R13938.1 R13939.1 R13940.1 R13941.1 R13942.1 R13943.1 R13944.1 R13945.1 R13946.1 R13947.1 R13948.1 R13949.1 R13950.1 R13951.1 R13952.1 R13953.1 R13954.1 R13955.1 R13956.1 R13957.1 R13958.1 R13959.1 R13960.1 R13961.1 R13962.1 R13963.1 R13964.1 R13965.1 R13966.1 R13967.1 R13968.1 R13969.1 R13970.1 R13971.1 R13972.1 R13973.1 R13974.1 R13975.1 R13976.1 R13977.1 R13978.1 R13979.1 R13980.1 R13981.1 R13982.1 R13983.1 R13984.1 R13985.1 R13986.1 R13987.1 R13988.1 R13989.1 R13990.1 R13991.1 R13992.1 R13993.1 R13994.1 R13995.1 R13996.1 R13997.1 R13998.1 R13999.1 R14000.1
N$78: R13801.2 R13802.2 R13803.2 R13804.2 R13805.2 R13806.2 R13807.2 R13808.2 R13809.2 R13810.2 R13811.2 R13812.2 R13813.2 R13814.2 R13815.2 R13816.2 R13817.2 R13818.2 R13819.2 R13820.2 R13821.2 R13822.2 R13823.2 R13824.2 R13825.2 R13826.2 R13827.2 R13828.2 R13829.2 R13830.2 R13831.2 R13832.2 R13833.2 R13834.2 R13835.2 R13836.2 R13837.2 R13838.2 R13839.2 R13840.2 R13841.2 R13842.2 R13843.2 R13844.2 R13845.2 R13846.2 R13847.2 R13848.2 R13849.2 R13850.2 R13851.2 R13852.2 R13853.2 R13854.2 R13855.2 R13856.2 R13857.2 R13858.2 R13859.2 R13860.2 R13861.2 R13862.2 R13863.2 R13864.2 R13865.2 R13866.2 R13867.2 R13868.2 R13869.2 R13870.2 R13871.2 R13872.2 R13873.2 R13874.2 R13875.2 R13876.2 R13877.2 R13878.2 R13879.2 R13880.2 R13881.2 R13882.2 R13883.2 R13884.2 R13885.2 R13886.2 R13887.2 R13888.2 R13889.2 R13890.2 R13891.2 R13892.2 R13893.2 R13894.2 R13895.2 R13896.2 R13897.2 R13898.2 R13899.2 R13900.2 R13901.2 R13902.2 R13903.2 R13904.2 R13905.2 R13906.2 R13907.2 R13908.2 R13909.2 R13910.2 R13911.2 R13912.2 R13913.2 R13914.2 R13915.2 R13916.2 R13917.2 R13918.2 R13919.2 R13920.2 R13921.2 R13922.2 R13923.2 R13924.2 R13925.2 R13926.2 R13927.2 R13928.2 R13929.2 R13930.2 R13931.2 R13932.2 R13933.2 R13934.2 R13935.2 R13936.2 R13937.2 R13938.2 R13939.2 R13940.2 R13941.2 R13942.2 R13943.2 R13944.2 R13945.2 R13946.2 R13947.2 R13948.2 R13949.2 R13950.2 R13951.2 R13952.2 R13953.2 R13954.2 R13955.2 R13956.2 R13957.2 R13958.2 R13959.2 R13960.2 R13961.2 R13962.2 R13963.2 R13964.2 R13965.2 R13966.2 R13967.2 R13968.2 R13969.2 R13970.2 R13971.2 R13972.2 R13973.2 R13974.2 R13975.2 R13976.2 R13977.2 R13978.2 R13979.2 R13980.2 R13981.2 R13982.2 R13983.2 R13984.2 R13985.2 R13986.2 R13987.2 R13988.2 R13989.2 R13990.2 R13991.2 R13992.2 R13993.2 R13994.2 R13995.2 R13996.2 R13997.2 R13998.2 R13999.2 R14000.2 R14001.1 R14002.1 R14003.1 R14004.1 R14005.1 R14006.1 R14007.1 R14008.1 R14009.1 R14010.1 R14011.1 R14012.1 R14013.1 R14014.1 R14015.1 R14016.1 R14017.1 R14018.1 R14019.1 R14020.1 R14021.1 R14022.1 R14023.1 R14024.1 R14025.1 R14026.1 R14027.1 R14028.1 R14029.1 R14030.1 R14031.1 R14032.1 R14033.1 R14034.1 R14035.1 R14036.1 R14037.1 R14038.1 R14039.1 R14040.1 R14041.1 R14042.1 R14043.1 R14044.1 R14045.1 R14046.1 R14047.1 R14048.1 R14049.1 R14050.1 R14051.1 R14052.1 R14053.1 R14054.1 R14055.1 R14056.1 R14057.1 R14058.1 R14059.1 R14060.1 R14061.1 R14062.1 R14063.1 R14064.1 R14065.1 R14066.1 R14067.1 R14068.1 R14069.1 R14070.1 R14071.1 R14072.1 R14073.1 R14074.1 R14075.1 R14076.1 R14077.1 R14078.1 R14079.1 R14080.1 R14081.1 R14082.1 R14083.1 R14084.1 R14085.1 R14086.1 R14087.1 R14088.1 R14089.1 R14090.1 R14091.1 R14092.1 R14093.1 R14094.1 R14095.1 R14096.1 R14097.1 R14098.1 R14099.1 R14100.1 R14101.1 R14102.1 R14103.1 R14104.1 R14105.1 R14106.1 R14107.1 R14108.1 R14109.1 R14110.1 R14111.1 R14112.1 R14113.1 R14114.1 R14115.1 R14116.1 R14117.1 R14118.1 R14119.1 R14120.1 R14121.1 R14122.1 R14123.1 R14124.1 R14125.1 R14126.1 R14127.1 R14128.1 R14129.1 R14130.1 R14131.1 R14132.1 R14133.1 R14134.1 R14135.1 R14136.1 R14137.1 R14138.1 R14139.1 R14140.1 R14141.1 R14142.1 R14143.1 R14144.1 R14145.1 R14146.1 R14147.1 R14148.1 R14149.1 R14150.1 R14151.1 R14152.1 R14153.1 R14154.1 R14155.1 R14156.1 R14157.1 R14158.1 R14159.1 R14160.1 R14161.1 R14162.1 R14163.1 R14164.1 R14165.1 R14166.1 R14167.1 R14168.1 R14169.1 R14170.1 R14171.1 R14172.1 R14173.1 R14174.1 R14175.1 R14176.1 R14177.1 R14178.1 R14179.1 R14180.1 R14181.1 R14182.1 R14183.1 R14184.1 R14185.1 R14186.1 R14187.1 R14188.1 R14189.1 R14190.1 R14191.1 R14192.1 R14193.1 R14194.1 R14195.1 R14196.1 R14197.1 R14198.1 R14199.1 R14200.1
N$79: R14001.2 R14002.2 R14003.2 R14004.2 R14005.2 R14006.2 R14007.2 R14008.2 R14009.2 R14010.2 R14011.2 R14012.2 R14013.2 R14014.2 R14015.2 R14016.2 R14017.2 R14018.2 R14019.2 R14020.2 R14021.2 R14022.2 R14023.2 R14024.2 R14025.2 R14026.2 R14027.2 R14028.2 R14029.2 R14030.2 R14031.2 R14032.2 R14033.2 R14034.2 R14035.2 R14036.2 R14037.2 R14038.2 R14039.2 R14040.2 R14041.2 R14042.2 R14043.2 R14044.2 R14045.2 R14046.2 R14047.2 R14048.2 R14049.2 R14050.2 R14051.2 R14052.2 R14053.2 R14054.2 R14055.2 R14056.2 R14057.2 R14058.2 R14059.2 R14060.2 R14061.2 R14062.2 R14063.2 R14064.2 R14065.2 R14066.2 R14067.2 R14068.2 R14069.2 R14070.2 R14071.2 R14072.2 R14073.2 R14074.2 R14075.2 R14076.2 R14077.2 R14078.2 R14079.2 R14080.2 R14081.2 R14082.2 R14083.2 R14084.2 R14085.2 R14086.2 R14087.2 R14088.2 R14089.2 R14090.2 R14091.2 R14092.2 R14093.2 R14094.2 R14095.2 R14096.2 R14097.2 R14098.2 R14099.2 R14100.2 R14101.2 R14102.2 R14103.2 R14104.2 R14105.2 R14106.2 R14107.2 R14108.2 R14109.2 R14110.2 R14111.2 R14112.2 R14113.2 R14114.2 R14115.2 R14116.2 R14117.2 R14118.2 R14119.2 R14120.2 R14121.2 R14122.2 R14123.2 R14124.2 R14125.2 R14126.2 R14127.2 R14128.2 R14129.2 R14130.2 R14131.2 R14132.2 R14133.2 R14134.2 R14135.2 R14136.2 R14137.2 R14138.2 R14139.2 R14140.2 R14141.2 R14142.2 R14143.2 R14144.2 R14145.2 R14146.2 R14147.2 R14148.2 R14149.2 R14150.2 R14151.2 R14152.2 R14153.2 R14154.2 R14155.2 R14156.2 R14157.2 R14158.2 R14159.2 R14160.2 R14161.2 R14162.2 R14163.2 R14164.2 R14165.2 R14166.2 R14167.2 R14168.2 R14169.2 R14170.2 R14171.2 R14172.2 R14173.2 R14174.2 R14175.2 R14176.2 R14177.2 R14178.2 R14179.2 R14180.2 R14181.2 R14182.2 R14183.2 R14184.2 R14185.2 R14186.2 R14187.2 R14188.2 R14189.2 R14190.2 R14191.2 R14192.2 R14193.2 R14194.2 R14195.2 R14196.2 R14197.2 R14198.2 R14199.2 R14200.2 R14201.1 R14202.1 R14203.1 R14204.1 R14205.1 R14206.1 R14207.1 R14208.1 R14209.1 R14210.1 R14211.1 R14212.1 R14213.1 R14214.1 R14215.1 R14216.1 R14217.1 R14218.1 R14219.1 R14220.1 R14221.1 R14222.1 R14223.1 R14224.1 R14225.1 R14226.1 R14227.1 R14228.1 R14229.1 R14230.1 R14231.1 R14232.1 R14233.1 R14234.1 R14235.1 R14236.1 R14237.1 R14238.1 R14239.1 R14240.1 R14241.1 R14242.1 R14243.1 R14244.1 R14245.1 R14246.1 R14247.1 R14248.1 R14249.1 R14250.1 R14251.1 R14252.1 R14253.1 R14254.1 R14255.1 R14256.1 R14257.1 R14258.1 R14259.1 R14260.1 R14261.1 R14262.1 R14263.1 R14264.1 R14265.1 R14266.1 R14267.1 R14268.1 R14269.1 R14270.1 R14271.1 R14272.1 R14273.1 R14274.1 R14275.1 R14276.1 R14277.1 R14278.1 R14279.1 R14280.1 R14281.1 R14282.1 R14283.1 R14284.1 R14285.1 R14286.1 R14287.1 R14288.1 R14289.1 R14290.1 R14291.1 R14292.1 R14293.1 R14294.1 R14295.1 R14296.1 R14297.1 R14298.1 R14299.1 R14300.1 R14301.1 R14302.1 R14303.1 R14304.1 R14305.1 R14306.1 R14307.1 R14308.1 R14309.1 R14310.1 R14311.1 R14312.1 R14313.1 R14314.1 R14315.1 R14316.1 R14317.1 R14318.1 R14319.1 R14320.1 R14321.1 R14322.1 R14323.1 R14324.1 R14325.1 R14326.1 R14327.1 R14328.1 R14329.1 R14330.1 R14331.1 R14332.1 R14333.1 R14334.1 R14335.1 R14336.1 R14337.1 R14338.1 R14339.1 R14340.1 R14341.1 R14342.1 R14343.1 R14344.1 R14345.1 R14346.1 R14347.1 R14348.1 R14349.1 R14350.1 R14351.1 R14352.1 R14353.1 R14354.1 R14355.1 R14356.1 R14357.1 R14358.1 R14359.1 R14360.1 R14361.1 R14362.1 R14363.1 R14364.1 R14365.1 R14366.1 R14367.1 R14368.1 R14369.1 R14370.1 R14371.1 R14372.1 R14373.1 R14374.1 R14375.1 R14376.1 R14377.1 R14378.1 R14379.1 R14380.1 R14381.1 R14382.1 R14383.1 R14384.1 R14385.1 R14386.1 R14387.1 R14388.1 R14389.1 R14390.1 R14391.1 R14392.1 R14393.1 R14394.1 R14395.1 R14396.1 R14397.1 R14398.1 R14399.1 R14400.1
N$80: R14201.2 R14202.2 R14203.2 R14204.2 R14205.2 R14206.2 R14207.2 R14208.2 R14209.2 R14210.2 R14211.2 R14212.2 R14213.2 R14214.2 R14215.2 R14216.2 R14217.2 R14218.2 R14219.2 R14220.2 R14221.2 R14222.2 R14223.2 R14224.2 R14225.2 R14226.2 R14227.2 R14228.2 R14229.2 R14230.2 R14231.2 R14232.2 R14233.2 R14234.2 R14235.2 R14236.2 R14237.2 R14238.2 R14239.2 R14240.2 R14241.2 R14242.2 R14243.2 R14244.2 R14245.2 R14246.2 R14247.2 R14248.2 R14249.2 R14250.2 R14251.2 R14252.2 R14253.2 R14254.2 R14255.2 R14256.2 R14257.2 R14258.2 R14259.2 R14260.2 R14261.2 R14262.2 R14263.2 R14264.2 R14265.2 R14266.2 R14267.2 R14268.2 R14269.2 R14270.2 R14271.2 R14272.2 R14273.2 R14274.2 R14275.2 R14276.2 R14277.2 R14278.2 R14279.2 R14280.2 R14281.2 R14282.2 R14283.2 R14284.2 R14285.2 R14286.2 R14287.2 R14288.2 R14289.2 R14290.2 R14291.2 R14292.2 R14293.2 R14294.2 R14295.2 R14296.2 R14297.2 R14298.2 R14299.2 R14300.2 R14301.2 R14302.2 R14303.2 R14304.2 R14305.2 R14306.2 R14307.2 R14308.2 R14309.2 R14310.2 R14311.2 R14312.2 R14313.2 R14314.2 R14315.2 R14316.2 R14317.2 R14318.2 R14319.2 R14320.2 R14321.2 R14322.2 R14323.2 R14324.2 R14325.2 R14326.2 R14327.2 R14328.2 R14329.2 R14330.2 R14331.2 R14332.2 R14333.2 R14334.2 R14335.2 R14336.2 R14337.2 R14338.2 R14339.2 R14340.2 R14341.2 R14342.2 R14343.2 R14344.2 R14345.2 R14346.2 R14347.2 R14348.2 R14349.2 R14350.2 R14351.2 R14352.2 R14353.2 R14354.2 R14355.2 R14356.2 R14357.2 R14358.2 R14359.2 R14360.2 R14361.2 R14362.2 R14363.2 R14364.2 R14365.2 R14366.2 R14367.2 R14368.2 R14369.2 R14370.2 R14371.2 R14372.2 R14373.2 R14374.2 R14375.2 R14376.2 R14377.2 R14378.2 R14379.2 R14380.2 R14381.2 R14382.2 R14383.2 R14384.2 R14385.2 R14386.2 R14387.2 R14388.2 R14389.2 R14390.2 R14391.2 R14392.2 R14393.2 R14394.2 R14395.2 R14396.2 R14397.2 R14398.2 R14399.2 R14400.2 R14401.1 R14402.1 R14403.1 R14404.1 R14405.1 R14406.1 R14407.1 R14408.1 R14409.1 R14410.1 R14411.1 R14412.1 R14413.1 R14414.1 R14415.1 R14416.1 R14417.1 R14418.1 R14419.1 R14420.1 R14421.1 R14422.1 R14423.1 R14424.1 R14425.1 R14426.1 R14427.1 R14428.1 R14429.1 R14430.1 R14431.1 R14432.1 R14433.1 R14434.1 R14435.1 R14436.1 R14437.1 R14438.1 R14439.1 R14440.1 R14441.1 R14442.1 R14443.1 R14444.1 R14445.1 R14446.1 R14447.1 R14448.1 R14449.1 R14450.1 R14451.1 R14452.1 R14453.1 R14454.1 R14455.1 R14456.1 R14457.1 R14458.1 R14459.1 R14460.1 R14461.1 R14462.1 R14463.1 R14464.1 R14465.1 R14466.1 R14467.1 R14468.1 R14469.1 R14470.1 R14471.1 R14472.1 R14473.1 R14474.1 R14475.1 R14476.1 R14477.1 R14478.1 R14479.1 R14480.1 R14481.1 R14482.1 R14483.1 R14484.1 R14485.1 R14486.1 R14487.1 R14488.1 R14489.1 R14490.1 R14491.1 R14492.1 R14493.1 R14494.1 R14495.1 R14496.1 R14497.1 R14498.1 R14499.1 R14500.1 R14501.1 R14502.1 R14503.1 R14504.1 R14505.1 R14506.1 R14507.1 R14508.1 R14509.1 R14510.1 R14511.1 R14512.1 R14513.1 R14514.1 R14515.1 R14516.1 R14517.1 R14518.1 R14519.1 R14520.1 R14521.1 R14522.1 R14523.1 R14524.1 R14525.1 R14526.1 R14527.1 R14528.1 R14529.1 R14530.1 R14531.1 R14532.1 R14533.1 R14534.1 R14535.1 R14536.1 R14537.1 R14538.1 R14539.1 R14540.1 R14541.1 R14542.1 R14543.1 R14544.1 R14545.1 R14546.1 R14547.1 R14548.1 R14549.1 R14550.1 R14551.1 R14552.1 R14553.1 R14554.1 R14555.1 R14556.1 R14557.1 R14558.1 R14559.1 R14560.1 R14561.1 R14562.1 R14563.1 R14564.1 R14565.1 R14566.1 R14567.1 R14568.1 R14569.1 R14570.1 R14571.1 R14572.1 R14573.1 R14574.1 R14575.1 R14576.1 R14577.1 R14578.1 R14579.1 R14580.1 R14581.1 R14582.1 R14583.1 R14584.1 R14585.1 R14586.1 R14587.1 R14588.1 R14589.1 R14590.1 R14591.1 R14592.1 R14593.1 R14594.1 R14595.1 R14596.1 R14597.1 R14598.1 R14599.1 R14600.1